# EasyEDA Pro project Cerberus_Power&Servo_V01_Test.eprj, schematic Cerberus_Power&amp;Servo_V01_Test

## Sheets
1 A1: Create Date: 2024-08-01; Page Name: A1; Project Name: Cerberus_Power&Servo_V01_Test; Schematic Name: Cerberus_Power&amp;Servo_V01_Test; Update Date: 2024-08-02; Company: 嘉立创EDA; Page Size: A3; Version: V1.0
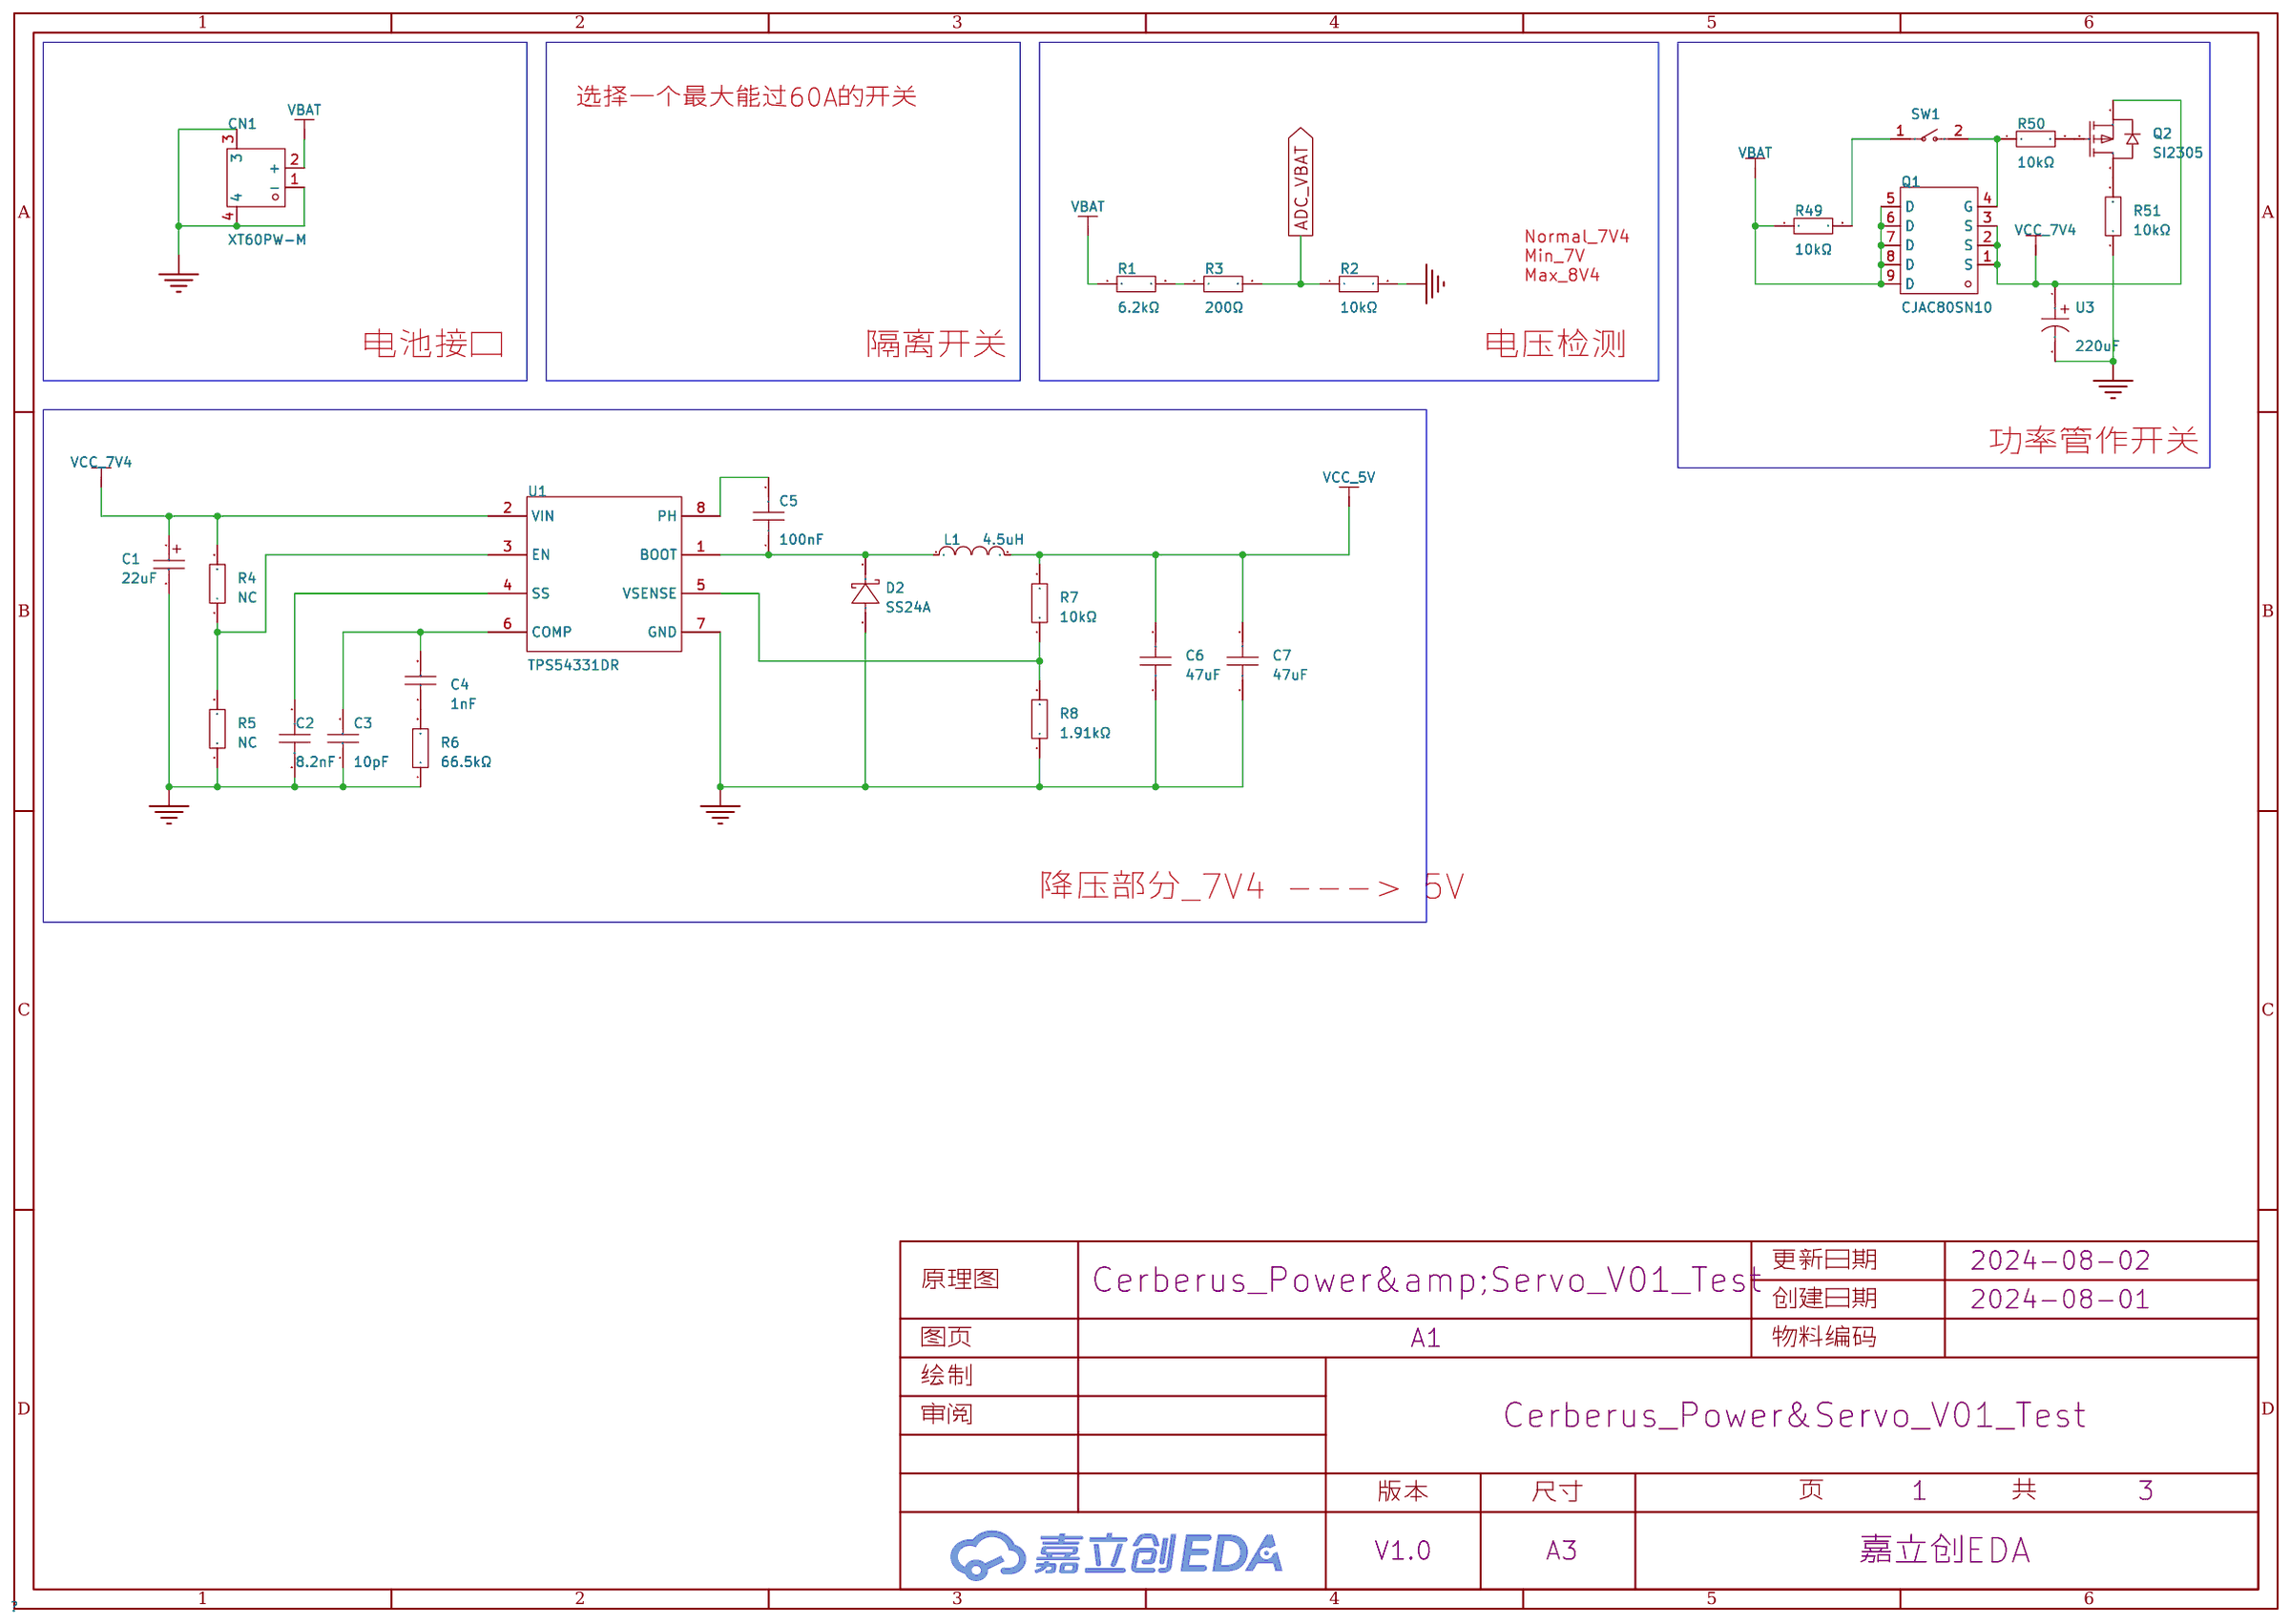
[diagram p0: A1]
2 A2: Create Date: 2024-08-02; Page Name: A2; Update Date: 2024-08-05
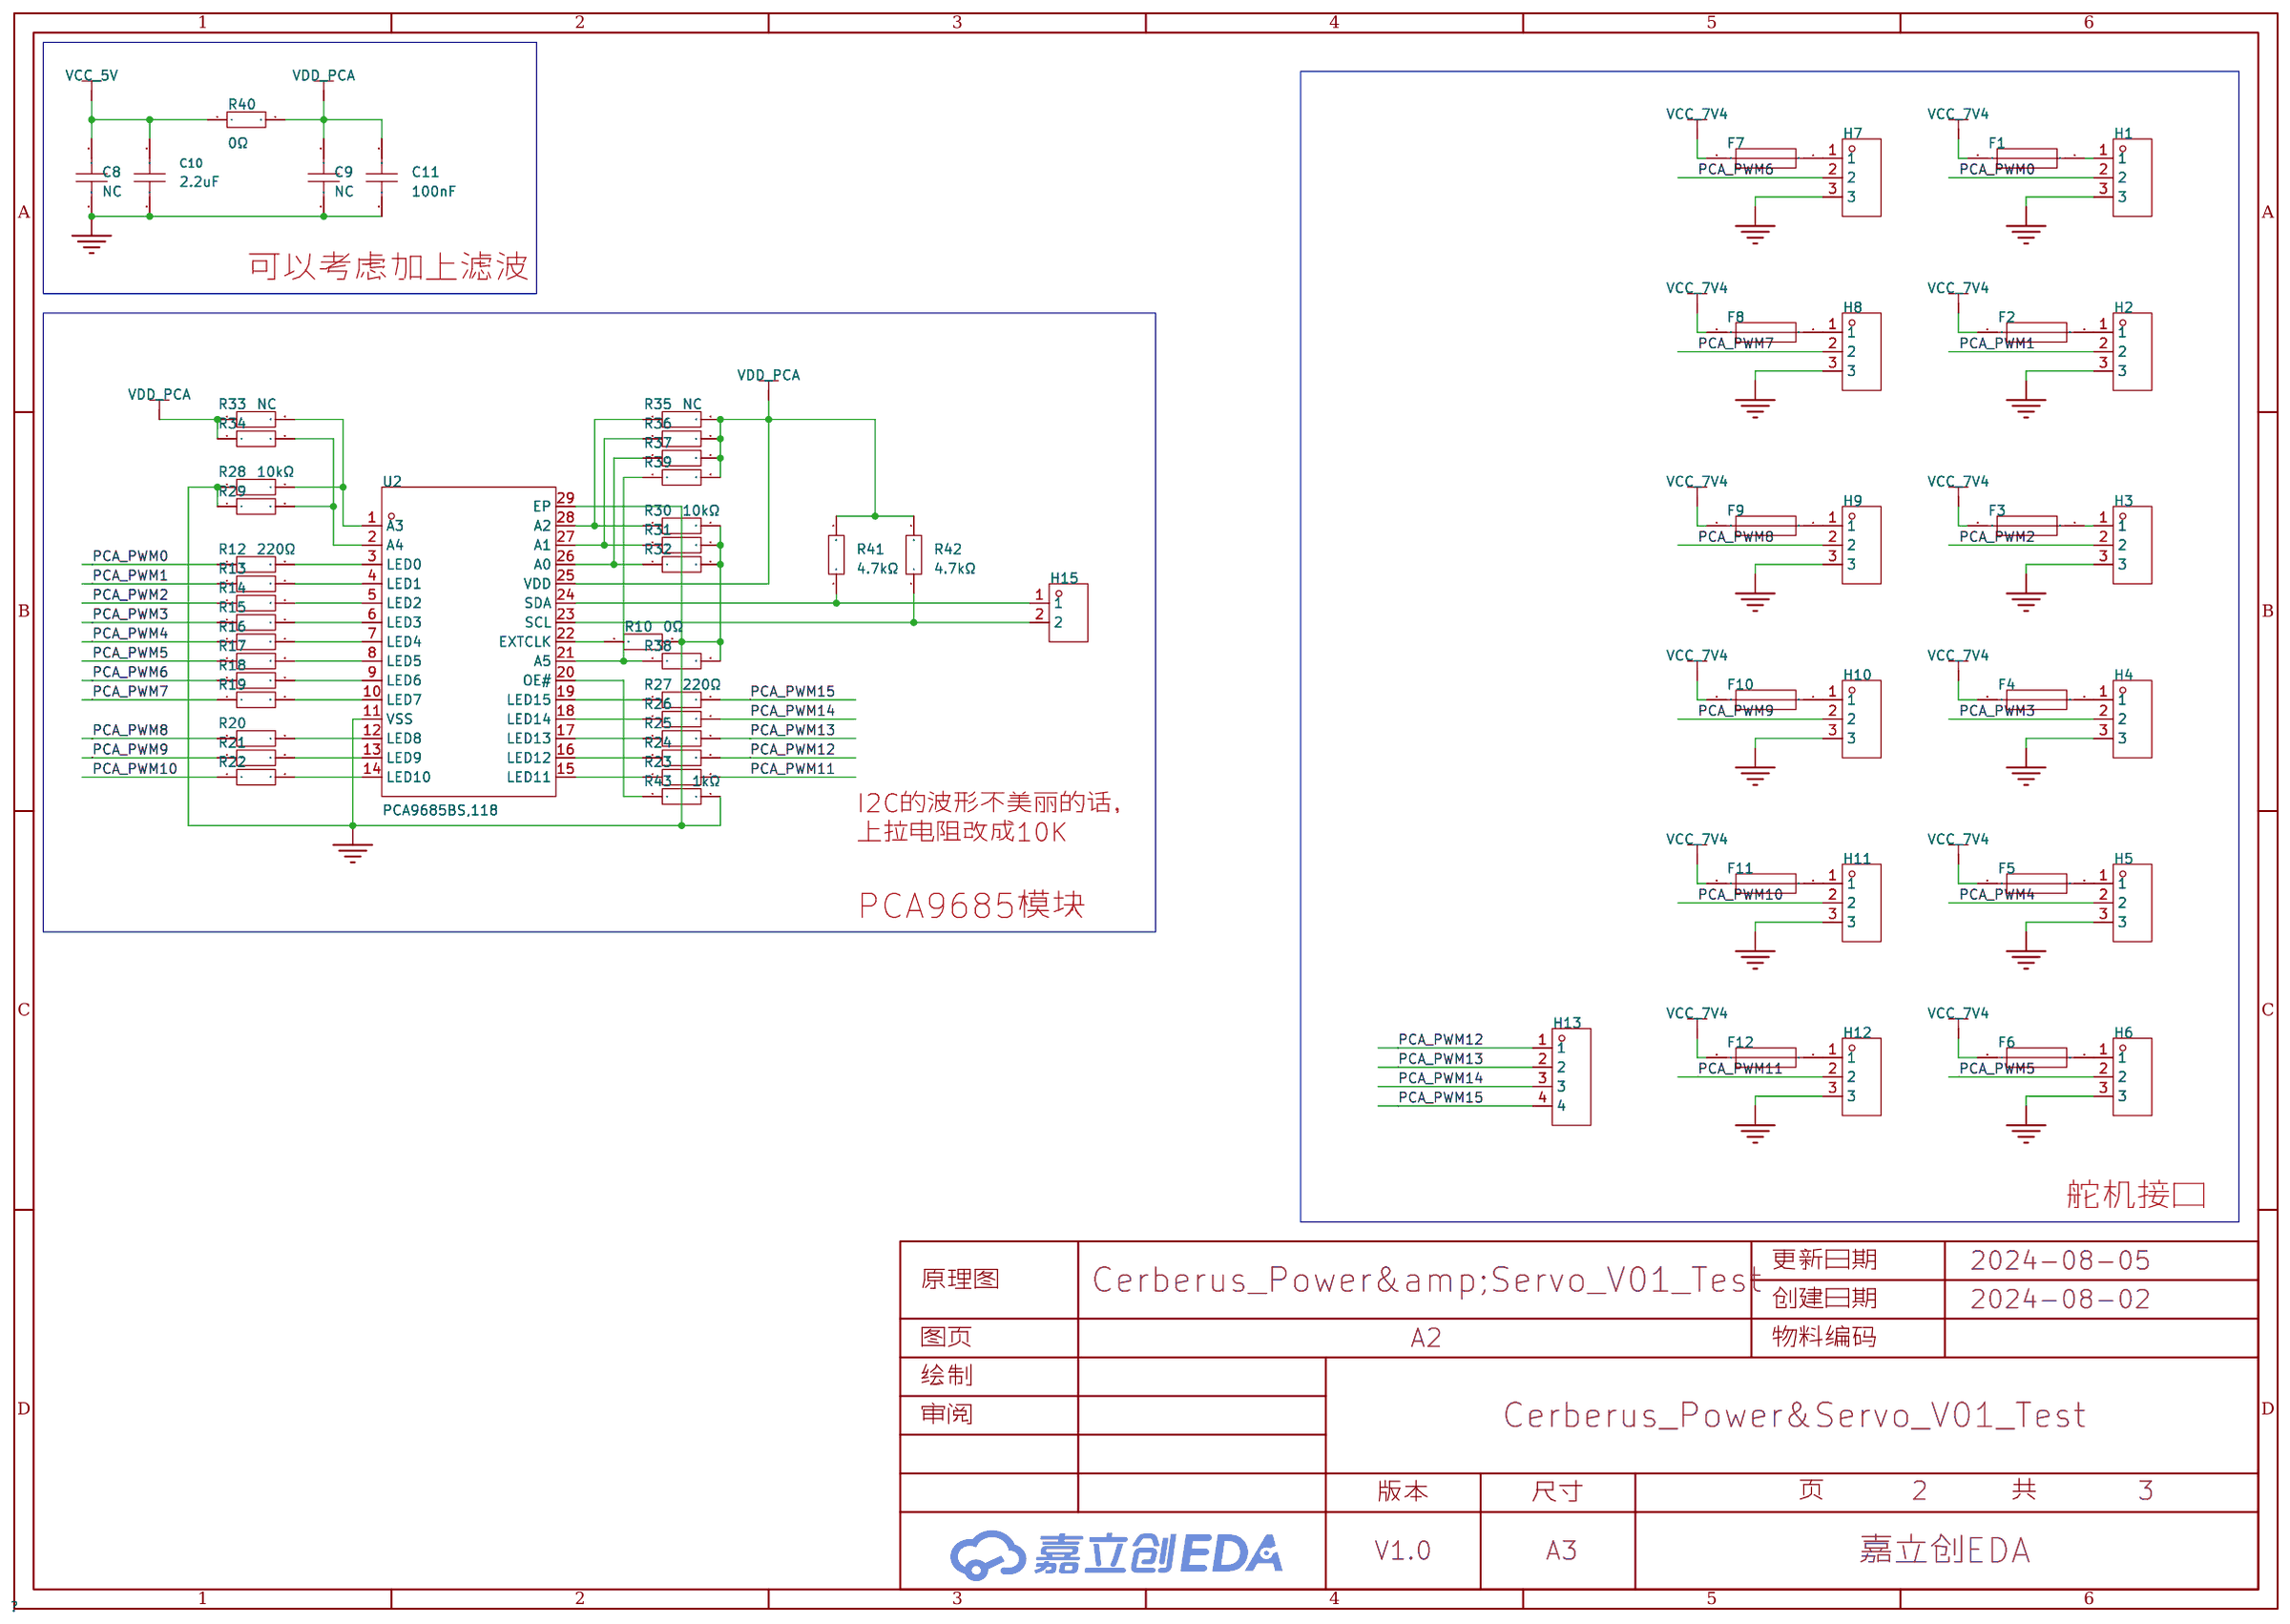
[diagram p1: A2]
3 A3: Create Date: 2024-08-02; Page Name: A3; Update Date: 2024-08-05
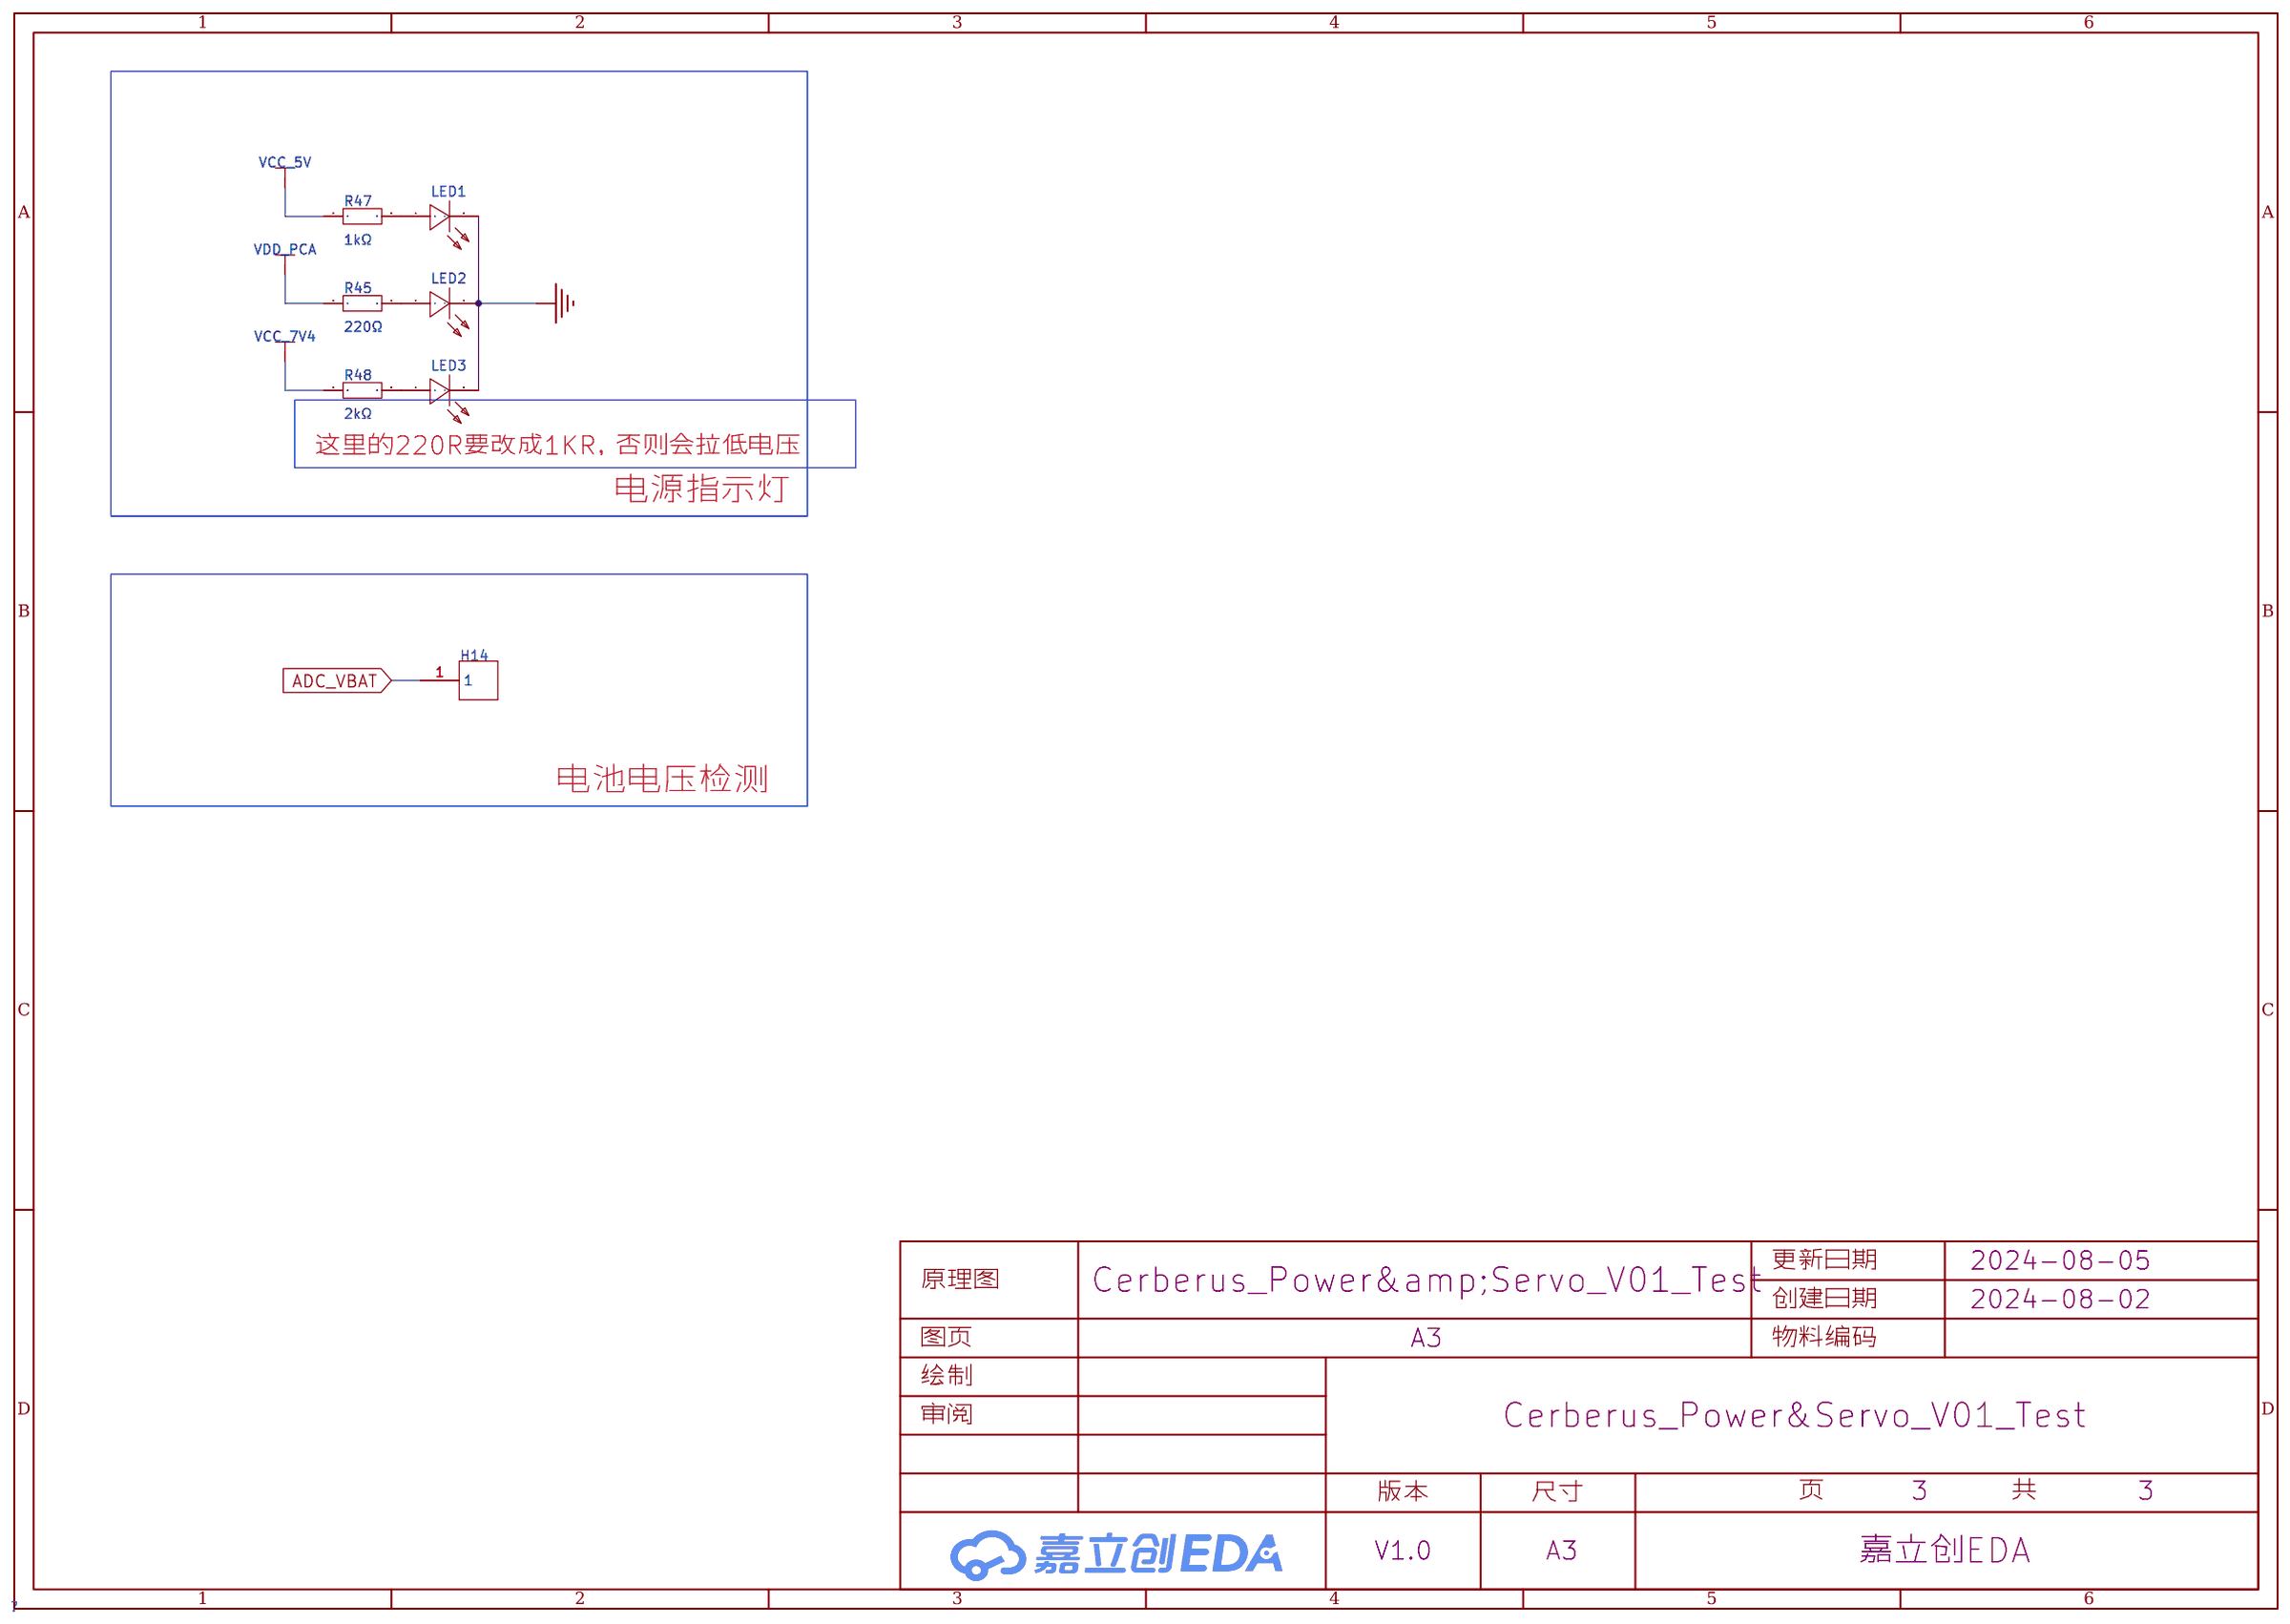
[diagram p2: A3]

## Parts
sheet A1
C1  22uF  [CASE-B_3528]
C2  8.2nF  [C0603]
C3  10pF  [C0603]
C4  1nF  [C0603]
C5  100nF  [C0603]
C6  47uF  [C0805]
C7  47uF  [C0805]
CN1  XT60PW-M  [CONN-TH_XT60PW-M]
D2  SS24A  [SMA_L4.4-W2.6-LS5.1-FD]
L1  4.5uH  [IND-SMD_L6.0-W6.0_FNR60XXS]
Q1  CJAC80SN10  [PDFN-8_L5.8-W5.0-P1.27-LS6.0-BL]
Q2  SI2305  [SOT-23-3_L2.9-W1.6-P1.90-LS2.8-BR]
R1  6.2kΩ  [R1206]
R2  10kΩ  [R1206]
R3  200Ω  [R1206]
R4  10kΩ  [R0603]
R5  10kΩ  [R0603]
R6  66.5kΩ  [R0603]
R7  10kΩ  [R0603]
R8  1.91kΩ  [R0603]
R49  10kΩ  [R0603]
R50  10kΩ  [R0603]
R51  10kΩ  [R1206]
SW1  KCD11-2P-R  [SW-TH_2P-L15.0-W10.5-P5.00_KCD11-2P-R]
U1  TPS54331DR  [SOIC-8_L5.0-W4.0-P1.27-LS6.0-BL]
U3  220uF  [CAP-SMD_BD8.0-L8.3-W8.3-LS9.1-FD]
sheet A2
C8  NC  [C0603]
C9  NC  [C0603]
C10  2.2uF  [C0603]
C11  100nF  [C0603]
F1  BSMD1812-200-16V  [F1812]
F2  BSMD1812-200-16V  [F1812]
F3  BSMD1812-200-16V  [F1812]
F4  BSMD1812-200-16V  [F1812]
F5  BSMD1812-200-16V  [F1812]
F6  BSMD1812-200-16V  [F1812]
F7  BSMD1812-200-16V  [F1812]
F8  BSMD1812-200-16V  [F1812]
F9  BSMD1812-200-16V  [F1812]
F10  BSMD1812-200-16V  [F1812]
F11  BSMD1812-200-16V  [F1812]
F12  BSMD1812-200-16V  [F1812]
H1  PZ254V-11-03P  [HDR-TH_3P-P2.54-V-M]
H2  PZ254V-11-03P  [HDR-TH_3P-P2.54-V-M]
H3  PZ254V-11-03P  [HDR-TH_3P-P2.54-V-M]
H4  PZ254V-11-03P  [HDR-TH_3P-P2.54-V-M]
H5  PZ254V-11-03P  [HDR-TH_3P-P2.54-V-M]
H6  PZ254V-11-03P  [HDR-TH_3P-P2.54-V-M]
H7  PZ254V-11-03P  [HDR-TH_3P-P2.54-V-M]
H8  PZ254V-11-03P  [HDR-TH_3P-P2.54-V-M]
H9  PZ254V-11-03P  [HDR-TH_3P-P2.54-V-M]
H10  PZ254V-11-03P  [HDR-TH_3P-P2.54-V-M]
H11  PZ254V-11-03P  [HDR-TH_3P-P2.54-V-M]
H12  PZ254V-11-03P  [HDR-TH_3P-P2.54-V-M]
H13  PZ254V-11-04P  [HDR-TH_4P-P2.54-V-M]
H15  PZ254V-11-02P  [HDR-TH_2P-P2.54-V-M]
R10  0Ω  [R0603]
R12  220Ω  [R0603]
R13  220Ω  [R0603]
R14  220Ω  [R0603]
R15  220Ω  [R0603]
R16  220Ω  [R0603]
R17  220Ω  [R0603]
R18  220Ω  [R0603]
R19  220Ω  [R0603]
R20  220Ω  [R0603]
R21  220Ω  [R0603]
R22  220Ω  [R0603]
R23  220Ω  [R0603]
R24  220Ω  [R0603]
R25  220Ω  [R0603]
R26  220Ω  [R0603]
R27  220Ω  [R0603]
R28  10kΩ  [R0603]
R29  10kΩ  [R0603]
R30  10kΩ  [R0603]
R31  10kΩ  [R0603]
R32  10kΩ  [R0603]
R33  NC  [R0603]
R34  NC  [R0603]
R35  NC  [R0603]
R36  NC  [R0603]
R37  NC  [R0603]
R38  10kΩ  [R0603]
R39  NC  [R0603]
R40  0Ω  [R1206]
R41  4.7kΩ  [R0603]
R42  4.7kΩ  [R0603]
R43  1kΩ  [R0603]
U2  PCA9685BS,118  [QFN-28_L6.0-W6.0-P0.65-TL-EP4.1]
sheet A3
H14  PZ254V-11-01P  [HDR-TH_1P-P2.54-V-M]
LED1  NCD0805R1  [LED0805-R-RD]
LED2  NCD0805R1  [LED0805-R-RD]
LED3  NCD0805R1  [LED0805-R-RD]
R45  220Ω  [R0603]
R47  1kΩ  [R0603]
R48  2kΩ  [R0603]

## Library data of the parts
C1 = TAJB226K016RNJ: 容值:22uF;精度:±10%;额定电压:16V;等效串联电阻:2.3Ω@100kHz;; LCSC Part Name: 22uF ±10% 16V; Supplier Part: C8020; Manufacturer: Kyocera AVX; Supplier Footprint: CASE-B-3528; JLCPCB Part Class: 扩展库; Datasheet: https://atta.szlcsc.com/upload/public/pdf/source/20160107/1457707750344.pdf; Supplier: LCSC; Tolerance: ±10%; Rated Voltage: 16V; Equivalent Series Resistance(ESR): 2.3Ω@100kHz; Operating Temperature: -55℃~+125℃
C2 = 0603B822K500NT: 容值:8.2nF;精度:±10%;额定电压:50V;材质(温度系数):X7R;; LCSC Part Name: 8.2nF ±10% 50V; Supplier Part: C1322360; Manufacturer: FH(风华); Supplier Footprint: 0603; JLCPCB Part Class: 基础库; Datasheet: https://atta.szlcsc.com/upload/public/pdf/source/20200305/C486355_26A10D38EF8C2A5C37091D0039909270.pdf; Supplier: LCSC; Tolerance: ±10%; Voltage Rated: 50V; Temperature Coefficient: X7R
C3 = CL10C100JB8NNNC: 容值:10pF;精度:±5%;额定电压:50V;材质(温度系数):C0G;; LCSC Part Name: 10pF ±5% 50V; Supplier Part: C1634; Manufacturer: SAMSUNG(三星); Supplier Footprint: 0603; JLCPCB Part Class: 基础库; Datasheet: https://atta.szlcsc.com/upload/public/pdf/source/20160218/1457707763339.pdf; Supplier: LCSC; Tolerance: ±5%; Voltage Rated: 50V; Temperature Coefficient: C0G
C4 = CC0603KRX7R9BB102: 容值:1nF;精度:±10%;额定电压:50V;材质(温度系数):X7R;; LCSC Part Name: 1nF ±10% 50V; Supplier Part: C100040; Manufacturer: YAGEO(国巨); Supplier Footprint: 0603; JLCPCB Part Class: 扩展库; Datasheet: https://atta.szlcsc.com/upload/public/pdf/source/20180910/C282072_33301C7F631E79921B82A8DAC6BCC5B3.pdf; Supplier: LCSC; Tolerance: ±10%; Voltage Rated: 50V; Temperature Coefficient: X7R
C5 C11 = CC0603KRX7R9BB104: 容值:100nF;精度:±10%;额定电压:50V;材质(温度系数):X7R;; LCSC Part Name: 100nF ±10% 50V; Supplier Part: C14663; Manufacturer: YAGEO(国巨); Supplier Footprint: 0603; JLCPCB Part Class: 基础库; Datasheet: https://atta.szlcsc.com/upload/public/pdf/source/20180910/C282072_33301C7F631E79921B82A8DAC6BCC5B3.pdf; Supplier: LCSC; Tolerance: ±10%; Voltage Rated: 50V; Temperature Coefficient: X7R
C6 C7 = CGA0805X5R476M100MT: 容值:47uF;精度:±20%;额定电压:10V;材质(温度系数):X5R;; LCSC Part Name: 47uF ±20% 10V; Supplier Part: C6119904; Manufacturer: HRE(芯声); Supplier Footprint: 0805; JLCPCB Part Class: 扩展库; Supplier: LCSC; Tolerance: ±20%; Voltage Rated: 10V; Temperature Coefficient: X5R
CN1 = XT60PW-M: 类别:-;类型1:-;; LCSC Part Name: AMASS(艾迈斯)航模插头xt60连接器150公母对接pw锂电池公头 板插卧式XT60PW-M; Supplier Part: C98732; Manufacturer: AMASS(艾迈斯); JLCPCB Part Class: 扩展库; Datasheet: https://atta.szlcsc.com/upload/public/pdf/source/20240118/44A3DCFF53BE25DC65378AFFB21277A4.pdf; Supplier: LCSC; Brand: 艾迈斯; Type: 卧式插头; Colour: 黄色; InterfaceType: 公头
D2 = SS24A: 二极管配置:独立式;正向压降(Vf):500mV@2A;直流反向耐压(Vr):40V;平均整流电流(Io):2A;; LCSC Part Name: 电压:40V 电流:2A; Supplier Part: C2886579; Manufacturer: Hottech(合科泰); Supplier Footprint: SMA(DO-214AC); JLCPCB Part Class: 扩展库; Datasheet: https://atta.szlcsc.com/upload/public/pdf/source/20210827/F72FA65B191CD3E4A90E227FAD6362F0.pdf; Supplier: LCSC; Diode Configuration: 独立式; Forward Voltage (Vf@If): 500mV@2A; Reverse Voltage (Vr): 40V; Average Rectified Current (Io): 2A; Reverse Leakage Current (Ir): 500uA@40V
L1 = FNR6045S4R5MT: 电感值:4.5uH;精度:±20%;额定电流:3.6A;饱和电流(Isat):5.5A;; LCSC Part Name: 4.5uH ±20% 5.5A; Supplier Part: C168066; Manufacturer: cjiang(长江微电); Supplier Footprint: SMD,6x6mm; JLCPCB Part Class: 扩展库; Datasheet: https://atta.szlcsc.com/upload/public/pdf/source/20190327/C167925_9EFF0AABC4CA629C2CC95961DBF7D39D.pdf; Supplier: LCSC; Tolerance: ±20%; Rated Current: 3.6A; Saturation Current (Isat): 5.5A; DC Resistance (DCR): 34mΩ
Q1 = CJAC80SN10: 类型:1个N沟道;漏源电压(Vdss):100V;连续漏极电流(Id):80A;功率(Pd):100W;导通电阻(RDS(on)@Vgs,Id):6.2mΩ@10V;阈值电压(Vgs(th)@Id):2.5V;; LCSC Part Name: 1个N沟道 耐压:100V 电流:80A; Supplier Part: C2913221; Manufacturer: CJ(江苏长电/长晶); Supplier Footprint: PDFN-8(5x6); JLCPCB Part Class: 扩展库; Datasheet: https://atta.szlcsc.com/upload/public/pdf/source/20211101/4F9ADD6ECF58ED50A240A9902BC9A3EC.pdf; Supplier: LCSC; Type: 1个N沟道; Drain Source Voltage (Vdss): 100V; Continuous Drain Current (Id): 80A; Power Dissipation (Pd): 100W; Drain Source On Resistance (RDS(on)@Vgs,Id): 6.2mΩ@10V; Gate Threshold Voltage (Vgs(th)@Id): 2.5V; Total Gate Charge (Qg@Vgs): 46nC; Input Capacitance (Ciss@Vds): 2.2nF; Reverse Transfer Capacitance (Crss@Vds): 6.3pF; Operating Temperature: -55℃~+150℃@(Tj)
Q2 = SI2305_C727153: 类型:-;漏源电压(Vdss):-;连续漏极电流(Id):-;功率(Pd):-;导通电阻(RDS(on)@Vgs,Id):-;阈值电压(Vgs(th)@Id):-;; Supplier Part: C727153; Manufacturer: TWGMC(台湾迪嘉); Supplier Footprint: SOT-23; JLCPCB Part Class: 扩展库; Datasheet: https://atta.szlcsc.com/upload/public/pdf/source/20200827/C727153_9B9B58BE4BA2C7EB6EE72B177984B8CA.pdf; Supplier: LCSC
R1 = RC1206FR-076K2L: 电阻类型:厚膜电阻;阻值:6.2kΩ;精度:±1%;功率:250mW;最大工作电压:200V;温度系数:±100ppm/℃;; LCSC Part Name: 厚膜电阻 6.2kΩ ±1% 250mW; Supplier Part: C137237; Manufacturer: YAGEO(国巨); Supplier Footprint: 1206; JLCPCB Part Class: 扩展库; Datasheet: https://atta.szlcsc.com/upload/public/pdf/source/20180224/C181757_15194369480721363983.pdf; Supplier: LCSC; Type: 厚膜电阻; Tolerance: ±1%; Power(Watts): 250mW; Overload Voltage (Max): 200V; Temperature Coefficient: ±100ppm/℃; Operating Temperature Range: -55℃~+155℃
R2 R51 = 1206W4F1002T5E: 电阻类型:厚膜电阻;阻值:10kΩ;精度:±1%;功率:250mW;最大工作电压:200V;温度系数:±100ppm/℃;; LCSC Part Name: 10kΩ ±1% 250mW 厚膜电阻; Supplier Part: C17902; Manufacturer: UNI-ROYAL(厚声); Supplier Footprint: 1206; JLCPCB Part Class: 基础库; Datasheet: https://atta.szlcsc.com/upload/public/pdf/source/20200306/C422600_1E6D84923E4A46A82E41ADD87F860B5C.pdf; Supplier: LCSC; Type: 厚膜电阻; Tolerance: ±1%; Power(Watts): 250mW; Overload Voltage (Max): 200V; Temperature Coefficient: ±100ppm/℃; Operating Temperature Range: -55℃~+155℃
R3 = 1206W4F2000T5E: 电阻类型:厚膜电阻;阻值:200Ω;精度:±1%;功率:250mW;最大工作电压:200V;温度系数:±100ppm/℃;; LCSC Part Name: 200Ω ±1% 250mW 厚膜电阻; Supplier Part: C18002; Manufacturer: UNI-ROYAL(厚声); Supplier Footprint: 1206; JLCPCB Part Class: 扩展库; Datasheet: https://atta.szlcsc.com/upload/public/pdf/source/20200306/C422600_1E6D84923E4A46A82E41ADD87F860B5C.pdf; Supplier: LCSC; Type: 厚膜电阻; Tolerance: ±1%; Power(Watts): 250mW; Overload Voltage (Max): 200V; Temperature Coefficient: ±100ppm/℃; Operating Temperature Range: -55℃~+155℃
R4 R5 R7 R28-R39 R49 R50 = 0603WAF1002T5E: 电阻类型:厚膜电阻;阻值:10kΩ;精度:±1%;功率:100mW;最大工作电压:75V;温度系数:±100ppm/℃;; LCSC Part Name: 厚膜电阻 10kΩ ±1% 100mW; Supplier Part: C25804; Manufacturer: UNI-ROYAL(厚声); Supplier Footprint: 0603; JLCPCB Part Class: 基础库; Datasheet: https://atta.szlcsc.com/upload/public/pdf/source/20200306/C422600_1E6D84923E4A46A82E41ADD87F860B5C.pdf; Supplier: LCSC; Type: 厚膜电阻; Tolerance: ±1%; Power(Watts): 100mW; Overload Voltage (Max): 75V; Temperature Coefficient: ±100ppm/℃; Operating Temperature Range: -55℃~+155℃
R6 = 0603WAF6652T5E: 电阻类型:厚膜电阻;阻值:66.5kΩ;精度:±1%;功率:100mW;最大工作电压:75V;温度系数:±100ppm/℃;; LCSC Part Name: 66.5kΩ ±1% 100mW 厚膜电阻; Supplier Part: C23225; Manufacturer: UNI-ROYAL(厚声); Supplier Footprint: 0603; JLCPCB Part Class: 扩展库; Datasheet: https://atta.szlcsc.com/upload/public/pdf/source/20200306/C422600_1E6D84923E4A46A82E41ADD87F860B5C.pdf; Supplier: LCSC; Type: 厚膜电阻; Tolerance: ±1%; Power(Watts): 100mW; Overload Voltage (Max): 75V; Temperature Coefficient: ±100ppm/℃; Operating Temperature Range: -55℃~+155℃
R8 = 0603WAF1911T5E: 电阻类型:厚膜电阻;阻值:1.91kΩ;精度:±1%;功率:100mW;最大工作电压:75V;温度系数:±100ppm/℃;; LCSC Part Name: 1.91kΩ ±1% 100mW 厚膜电阻; Supplier Part: C22853; Manufacturer: UNI-ROYAL(厚声); Supplier Footprint: 0603; JLCPCB Part Class: 扩展库; Datasheet: https://atta.szlcsc.com/upload/public/pdf/source/20200306/C422600_1E6D84923E4A46A82E41ADD87F860B5C.pdf; Supplier: LCSC; Type: 厚膜电阻; Tolerance: ±1%; Power(Watts): 100mW; Overload Voltage (Max): 75V; Temperature Coefficient: ±100ppm/℃; Operating Temperature Range: -55℃~+155℃
SW1 = KCD11-2P-R: 带灯:无;引脚样式:焊片;额定电流:3A;额定电压(AC):250V;额定电压(DC):-;电路结构:单刀单掷;机械寿命:1万次;; LCSC Part Name: 10.5*15mm 两脚两档跷板开关 红钮; Supplier Part: C5884414; Manufacturer: SHOU HAN(首韩); Supplier Footprint: 插件; JLCPCB Part Class: 扩展库; Datasheet: https://atta.szlcsc.com/upload/public/pdf/source/20230506/CD06DFDE35C8048D34175BFF4AF6A2C2.pdf; Supplier: LCSC; Switch Length: 15mm; Switch Width: 10.5mm; Switch Height: 17.2mm; Actuator Type: 凹面弯曲; With Lamp: 无; Pin Style: 焊片; Actuator Color: 红色; Contact Current: 3A; Voltage Rating (AC): 250V; Circuit: 单刀单掷; Mechanical Life: 1万次; Operating Temperature: 0℃~+125℃; Actuator Identifier: - O
U1 = TPS54331DR: 功能类型:降压型;输出类型:可调;输入电压:3.5V~28V;输出电压:800mV~25V;输出电流(最大值):3A;; Supplier Part: C9865; Manufacturer: TI(德州仪器); Supplier Footprint: SOIC-8; JLCPCB Part Class: 扩展库; Datasheet: https://www.ti.com/cn/lit/gpn/tps54331; Supplier: LCSC; Function: 降压型; Output Type: 可调; Input Voltage: 3.5V~28V; Output Voltage: 800mV~25V; Output Current (Max): 3A; Switching Frequency: 570kHz; Operating Temperature: -40℃~+150℃@(TJ); Synchronous Rectification: 否; Number of Outputs: 1; Topology: 降压式; Switch tube (built-in/external): 内置
U3 = RST220UF35V022: 容值:220uF;精度:±20%;额定电压:35V;纹波电流:190mA@120Hz;等效串联电阻:-;; LCSC Part Name: 220uF ±20% 35V; Supplier Part: C4747976; Manufacturer: KNSCHA(科尼盛); Supplier Footprint: SMD,D8xL10.5mm; JLCPCB Part Class: 扩展库; Datasheet: https://atta.szlcsc.com/upload/public/pdf/source/20220722/7BA26198AF0FEDCD26F9FC241DC3B32C.pdf; Supplier: LCSC; Tolerance: ±20%; Rated Voltage: 35V; Ripple Current: 190mA@120Hz; φD: 8mm; L: 10.5mm; Lifetime @ Temp: 2000hrs@105℃; Operating Temperature: -40℃~+105℃
C8 C9 = CL10A106MA8NRNC: 容值:10uF;精度:±20%;额定电压:25V;材质(温度系数):X5R;; LCSC Part Name: 10uF ±20% 25V; Supplier Part: C96446; Manufacturer: SAMSUNG(三星); Supplier Footprint: 0603; JLCPCB Part Class: 基础库; Datasheet: https://atta.szlcsc.com/upload/public/pdf/source/20160218/1457707763339.pdf; Supplier: LCSC; Tolerance: ±20%; Voltage Rated: 25V; Temperature Coefficient: X5R
C10 = CL10A225KB8NNNC: 容值:2.2uF;精度:±10%;额定电压:50V;材质(温度系数):X5R;; LCSC Part Name: 2.2uF ±10% 50V; Supplier Part: C913904; Manufacturer: SAMSUNG(三星); Supplier Footprint: 0603; JLCPCB Part Class: 扩展库; Datasheet: https://atta.szlcsc.com/upload/public/pdf/source/20160218/1457707763339.pdf; Supplier: LCSC; Tolerance: ±10%; Voltage Rated: 50V; Temperature Coefficient: X5R
F1-F12 = BSMD1812-200-16V: 最大电压:16V;最大电流:100A;保持电流:2A;跳闸电流:4A;; LCSC Part Name: 16V 2A 1812自恢复; Supplier Part: C883156; Manufacturer: BHFUSE(佰宏); Supplier Footprint: 1812; JLCPCB Part Class: 扩展库; Datasheet: https://atta.szlcsc.com/upload/public/pdf/source/20230512/6ED7FF50F668B3AF958C55F12246A840.pdf; Supplier: LCSC; Operating Voltage (Max): 16V; Current Rating (Max): 100A; Hold Current: 2A; Trip Current: 4A; Power Dissipation: 1W; Resistance - Initial (Ri) (Min): 20mΩ; Resistance - Post Trip (R1) (Max): 100mΩ; Maximum Time to Trip: 2s; Operating Temperature: -40℃~+85℃
H1-H12 = PZ254V-11-03P: 插针结构:1x3P;间距:2.54mm;行距:-;圆针/方针:方针;安装类型:直插;排数:单排;总PIN位数:3P;额定电流:3A;额定电压:250V;配合针长度:6mm;塑高:2.5mm;端接针长度:3mm;工作温度范围:-40℃~+105℃;颜色:黑色;; LCSC Part Name: 间距:2.54mm 1x3P 直插 方针; Supplier Part: C2937625; Manufacturer: XFCN(兴飞); Supplier Footprint: 插件,P=2.54mm; JLCPCB Part Class: 扩展库; Datasheet: https://atta.szlcsc.com/upload/public/pdf/source/20200309/C492402_8335C3D49C4E4C618838D59BB1D024C1.pdf; Supplier: LCSC; Pin Structure: 1x3P; Pitch: 2.54mm; Circluar Pins/Square Pins: 方针; Mounting Type: 直插; Number of Rows: 单排; Number of Pins: 3P; Current Rating (Max): 3A; Voltage Rating (Max): 250V; Length of Mating Pin: 6mm; Insulation Height: 2.5mm; Length of End Connection Pin: 3mm; Operating Temperature Range: -40℃~+105℃; Color: 黑色
H13 = PZ254V-11-04P: 插针结构:1x4P;间距:2.54mm;行距:-;圆针/方针:方针;安装类型:直插;排数:单排;总PIN位数:4P;额定电流:3A;额定电压:250V;配合针长度:6mm;塑高:2.5mm;端接针长度:3mm;触头材质:-;工作温度范围:-40℃~+105℃;颜色:黑色;; LCSC Part Name: 间距:2.54mm 1x4P 直插 方针; Supplier Part: C2691448; Manufacturer: XFCN(兴飞); Supplier Footprint: 插件,P=2.54mm; JLCPCB Part Class: 扩展库; Datasheet: https://atta.szlcsc.com/upload/public/pdf/source/20200309/C492403_F9F19131791D08044AD4F84F8E751A34.pdf; Supplier: LCSC; Pin Structure: 1x4P; Pitch: 2.54mm; Circluar Pins/Square Pins: 方针; Mounting Type: 直插; Number of Rows: 单排; Number of Pins: 4P; Current Rating (Max): 3A; Voltage Rating (Max): 250V; Length of Mating Pin: 6mm; Insulation Height: 2.5mm; Length of End Connection Pin: 3mm; Operating Temperature Range: -40℃~+105℃; Color: 黑色
H15 = PZ254V-11-02P: 插针结构:1x2P;间距:2.54mm;行距:-;圆针/方针:方针;安装类型:直插;排数:单排;总PIN位数:2P;额定电流:-;额定电压:-;配合针长度:6mm;塑高:2.5mm;端接针长度:3mm;触头材质:黄铜;触头镀层:-;工作温度范围:-40℃~+105℃;颜色:黑色;; LCSC Part Name: 间距:2.54mm 1x2P 直插 方针; Supplier Part: C492401; Manufacturer: XFCN(兴飞); Supplier Footprint: 插件,P=2.54mm; JLCPCB Part Class: 扩展库; Datasheet: https://atta.szlcsc.com/upload/public/pdf/source/20200309/C492401_A812433581A9B211A7FFA413ADDFF0E5.pdf; Supplier: LCSC; Pin Structure: 1x2P; Pitch: 2.54mm; Circluar Pins/Square Pins: 方针; Mounting Type: 直插; Number of Rows: 单排; Number of Pins: 2P; Length of Mating Pin: 6mm; Insulation Height: 2.5mm; Length of End Connection Pin: 3mm; Contact Material: 黄铜; Operating Temperature Range: -40℃~+105℃; Color: 黑色
R10 = 0603WAF0000T5E: 电阻类型:厚膜电阻;阻值:0Ω;精度:±1%;功率:100mW;最大工作电压:75V;; LCSC Part Name: 0Ω ±1% 100mW 厚膜电阻; Supplier Part: C21189; Manufacturer: UNI-ROYAL(厚声); Supplier Footprint: 0603; JLCPCB Part Class: 基础库; Datasheet: https://atta.szlcsc.com/upload/public/pdf/source/20200306/C422600_1E6D84923E4A46A82E41ADD87F860B5C.pdf; Supplier: LCSC; Type: 厚膜电阻; Tolerance: ±1%; Power(Watts): 100mW; Overload Voltage (Max): 75V; Operating Temperature Range: -55℃~+155℃
R12-R27 R45 = 0603WAF2200T5E: 电阻类型:厚膜电阻;阻值:220Ω;精度:±1%;功率:100mW;最大工作电压:75V;温度系数:±100ppm/℃;; LCSC Part Name: 220Ω ±1% 100mW 厚膜电阻; Supplier Part: C22962; Manufacturer: UNI-ROYAL(厚声); Supplier Footprint: 0603; JLCPCB Part Class: 基础库; Datasheet: https://atta.szlcsc.com/upload/public/pdf/source/20200306/C422600_1E6D84923E4A46A82E41ADD87F860B5C.pdf; Supplier: LCSC; Type: 厚膜电阻; Tolerance: ±1%; Power(Watts): 100mW; Overload Voltage (Max): 75V; Temperature Coefficient: ±100ppm/℃; Operating Temperature Range: -55℃~+155℃
R40 = 1206W4F0000T5E: 电阻类型:厚膜电阻;阻值:0Ω;精度:±1%;功率:250mW;最大工作电压:200V;温度系数:±800ppm/℃;; LCSC Part Name: 0Ω ±1% 250mW 厚膜电阻; Supplier Part: C17888; Manufacturer: UNI-ROYAL(厚声); Supplier Footprint: 1206; JLCPCB Part Class: 基础库; Datasheet: https://atta.szlcsc.com/upload/public/pdf/source/20200306/C422600_1E6D84923E4A46A82E41ADD87F860B5C.pdf; Supplier: LCSC; Type: 厚膜电阻; Tolerance: ±1%; Power(Watts): 250mW; Overload Voltage (Max): 200V; Temperature Coefficient: ±800ppm/℃; Operating Temperature Range: -55℃~+155℃
R41 R42 = RC0603FR-074K7L: 电阻类型:厚膜电阻;阻值:4.7kΩ;精度:±1%;功率:100mW;最大工作电压:75V;温度系数:±100ppm/℃;; LCSC Part Name: 厚膜电阻 4.7kΩ ±1% 100mW; Supplier Part: C99782; Manufacturer: YAGEO(国巨); Supplier Footprint: 0603; JLCPCB Part Class: 扩展库; Datasheet: https://atta.szlcsc.com/upload/public/pdf/source/20180224/C181757_15194369480721363983.pdf; Supplier: LCSC; Type: 厚膜电阻; Tolerance: ±1%; Power(Watts): 100mW; Overload Voltage (Max): 75V; Temperature Coefficient: ±100ppm/℃; Operating Temperature Range: -55℃~+155℃
R43 R47 = RC0603FR-071KL: 电阻类型:厚膜电阻;阻值:1kΩ;精度:±1%;功率:100mW;最大工作电压:75V;温度系数:±100ppm/℃;; LCSC Part Name: 厚膜电阻 1kΩ ±1% 100mW; Supplier Part: C22548; Manufacturer: YAGEO(国巨); Supplier Footprint: 0603; JLCPCB Part Class: 扩展库; Datasheet: https://atta.szlcsc.com/upload/public/pdf/source/20180316/70C0E2BDAE7FCC62C531A5A58D202EE1.pdf; Supplier: LCSC; Type: 厚膜电阻; Tolerance: ±1%; Power(Watts): 100mW; Overload Voltage (Max): 75V; Temperature Coefficient: ±100ppm/℃; Operating Temperature Range: -55℃~+155℃
U2 = PCA9685BS,118: 输入电压:2.3V~5.5V;; Supplier Part: C5191634; Manufacturer: NXP(恩智浦); Supplier Footprint: SOT-788-1; JLCPCB Part Class: 扩展库; Datasheet: https://atta.szlcsc.com/upload/public/pdf/source/20170908/C92206_1504870161626958140.pdf; Supplier: LCSC; Input Voltage: 2.3V~5.5V; Operating temperature: -40℃~+85℃
H14 = PZ254V-11-01P: 插针结构:1x1P;间距:2.54mm;行距:-;圆针/方针:方针;安装类型:直插;排数:单排;总PIN位数:1P;额定电流:-;额定电压:-;配合针长度:6mm;塑高:2.5mm;端接针长度:3mm;触头材质:黄铜;触头镀层:-;工作温度范围:-40℃~+105℃;颜色:黑色;; LCSC Part Name: 间距:2.54mm 1x1P 直插 方针; Supplier Part: C492400; Manufacturer: XFCN(兴飞); Supplier Footprint: 插件,P=2.54mm; JLCPCB Part Class: Extended Part; Datasheet: https://atta.szlcsc.com/upload/public/pdf/source/20200309/C492400_46876A5B545F5AE6B8D4A09C46E276E8.pdf; Supplier: LCSC; Pin Structure: 1x1P; Pitch: 2.54mm; Circluar Pins/Square Pins: 方针; Mounting Type: 直插; Number of Rows: 单排; Number of Pins: 1P; Length of Mating Pin: 6mm; Insulation Height: 2.5mm; Length of End Connection Pin: 3mm; Contact Material: 黄铜; Operating Temperature Range: -40℃~+105℃; Color: 黑色
LED1-LED3 = NCD0805R1: 灯头类型:-;发光颜色:红色;正向电压(VF):1.6V~2.6V;功率:65mW;正向电流:20mA;主波长:615nm~630nm;二极管配置:独立二极管;透镜颜色:无色透明透镜;色温:-;发光强度:67mcd~195mcd;发光角度:130°;载带方式:-;工作温度:-30℃~+85℃;; Supplier Part: C84256; Manufacturer: 国星光电; Supplier Footprint: 0805; JLCPCB Part Class: 基础库; Datasheet: https://atta.szlcsc.com/upload/public/pdf/source/20200820/C84256_F0A75A43B3EAD75808600A0514C76B99.pdf; Supplier: LCSC; Emitted Color: 红色; Forward Voltage (VF): 1.6V~2.6V; Power Dissipation: 65mW; Forward Current: 20mA; Dominant Wavelength: 615nm~630nm; Diode Configuration: 独立二极管; Lens Color: 无色透明透镜; Luminous Intensity: 67mcd~195mcd; Viewing Angle: 130°; Operating Temperature: -30℃~+85℃
R48 = 0603WAF2001T5E: 电阻类型:厚膜电阻;阻值:2kΩ;精度:±1%;功率:100mW;最大工作电压:75V;温度系数:±100ppm/℃;; LCSC Part Name: 2kΩ ±1% 100mW 厚膜电阻; Supplier Part: C22975; Manufacturer: UNI-ROYAL(厚声); Supplier Footprint: 0603; JLCPCB Part Class: 基础库; Datasheet: https://atta.szlcsc.com/upload/public/pdf/source/20200306/C422600_1E6D84923E4A46A82E41ADD87F860B5C.pdf; Supplier: LCSC; Type: 厚膜电阻; Tolerance: ±1%; Power(Watts): 100mW; Overload Voltage (Max): 75V; Temperature Coefficient: ±100ppm/℃; Operating Temperature Range: -55℃~+155℃

## Nets
GND: C1.2 C2.2 C3.1 C6.1 C7.1 C8.1 C9.1 C10.1 C11.1 CN1.1(-) CN1.3 CN1.4 D2.1(A) H1.3 H2.3 H3.3 H4.3 H5.3 H6.3 H7.3 H8.3 H9.3 H10.3 H11.3 H12.3 LED1.2(-) LED2.2(-) LED3.2(-) R2.2 R5.1 R6.1 R8.1 R10.2 R28.1 R29.1 R30.2 R31.2 R32.2 R38.2 R43.2 R51.1 U1.7(GND) U2.11(VSS) U2.29(EP) U3.2
VBAT: CN1.2(+) Q1.5(D) Q1.6(D) Q1.7(D) Q1.8(D) Q1.9(D) R1.1 R49.1
VCC_5V: C6.2 C7.2 C8.2 C10.2 L1.2 R7.2 R40.1 R47.1
VCC_7V4: C1.1 F1.1 F2.1 F3.1 F4.1 F5.1 F6.1 F7.1 F8.1 F9.1 F10.1 F11.1 F12.1 Q1.1(S) Q1.2(S) Q1.3(S) Q2.2(S) R4.2 R48.1 U1.2(VIN) U3.1
VDD_PCA: C9.2 C11.2 R33.1 R34.1 R35.2 R36.2 R37.2 R39.2 R40.2 R41.2 R42.2 R45.1 U2.25(VDD)
ADC_VBAT: H14.1 R2.1 R3.2
PCA_PWM0: H1.2 R12.1
PCA_PWM1: H2.2 R13.1
PCA_PWM2: H3.2 R14.1
PCA_PWM3: H4.2 R15.1
PCA_PWM4: H5.2 R16.1
PCA_PWM5: H6.2 R17.1
PCA_PWM6: H7.2 R18.1
PCA_PWM7: H8.2 R19.1
PCA_PWM8: H9.2 R20.1
PCA_PWM9: H10.2 R21.1
PCA_PWM10: H11.2 R22.1
PCA_PWM11: H12.2 R23.2
PCA_PWM12: H13.1 R24.2
PCA_PWM13: H13.2 R25.2
PCA_PWM14: H13.3 R26.2
PCA_PWM15: H13.4 R27.2
$1N560: R1.2 R3.1
$1N913: R4.1 R5.2 U1.3(EN)
$1N1409: C5.2 U1.8(PH)
$1N1671: C5.1 D2.2(K) L1.1 U1.1(BOOT)
$1N1830: R7.1 R8.2 U1.5(VSENSE)
$1N2590: R49.2 SW1.1
$1N2606: Q1.4(G) R50.1 SW1.2
$1N3521: C2.1 U1.4(SS)
$1N3609: C3.2 C4.2 U1.6(COMP)
$1N3610: C4.1 R6.2
$1N4187: Q2.1(G) R50.2
$1N4299: Q2.3(D) R51.2
$2N354: R10.1 U2.22(EXTCLK)
$2N1919: R12.2 U2.3(LED0)
$2N1922: R13.2 U2.4(LED1)
$2N1925: R14.2 U2.5(LED2)
$2N1928: R15.2 U2.6(LED3)
$2N1931: R16.2 U2.7(LED4)
$2N1934: R17.2 U2.8(LED5)
$2N1937: R18.2 U2.9(LED6)
$2N1940: R19.2 U2.10(LED7)
$2N1943: R20.2 U2.12(LED8)
$2N1946: R21.2 U2.13(LED9)
$2N1949: R22.2 U2.14(LED10)
$2N1952: R23.1 U2.15(LED11)
$2N1955: R24.1 U2.16(LED12)
$2N1971: R25.1 U2.17(LED13)
$2N1974: R26.1 U2.18(LED14)
$2N1977: R27.1 U2.19(LED15)
$2N2373: R28.2 R33.2 U2.1(A3)
$2N2387: R29.2 R34.2 U2.2(A4)
$2N2534: R30.1 R35.1 U2.28(A2)
$2N2543: R31.1 R36.1 U2.27(A1)
$2N2560: R32.1 R37.1 U2.26(A0)
$2N2720: R38.1 R39.1 U2.21(A5)
$2N3517: R43.1 U2.20(OE#)
$4N386: LED2.1(+) R45.2
$4N862: LED1.1(+) R47.2
$4N975: LED3.1(+) R48.2
Net-(F1-2): F1.2 H1.1
Net-(F2-2): F2.2 H2.1
Net-(F3-2): F3.2 H3.1
Net-(F4-2): F4.2 H4.1
Net-(F5-2): F5.2 H5.1
Net-(F6-2): F6.2 H6.1
Net-(F7-2): F7.2 H7.1
Net-(F8-2): F8.2 H8.1
Net-(F9-2): F9.2 H9.1
Net-(F10-2): F10.2 H10.1
Net-(F11-2): F11.2 H11.1
Net-(F12-2): F12.2 H12.1
Net-(H15-1): H15.1 R41.1 U2.24(SDA)
Net-(H15-2): H15.2 R42.1 U2.23(SCL)

## Notes on the sheets
sheet 1
- 选择一个最大能过60A的开关
- Normal_7V4
  Min_7V
  Max_8V4
- 电池接口
- 隔离开关
- 电压检测
- 功率管作开关
- 降压部分_7V4 ---> 5V
sheet 2
- 可以考虑加上滤波
- I2C的波形不美丽的话，
  上拉电阻改成10K
- PCA9685模块
- 舵机接口
sheet 3
- 这里的220R要改成1KR，否则会拉低电压
- 电源指示灯
- 电池电压检测
